# EAGLE board Copypaste (EAGLE 7.6.0), part 2 of 2
## Tracks (layer width: path | path; a pad name or v marks a point on that pad's centre or on a via)
A0  (1 unrouted)
A1  (1 unrouted)
A2  (1 unrouted)
A3  (1 unrouted)
A4
  Top 0.178: SJ4.2 16.73,71.18 17.53,70.38 17.53,63.3 16.15,61.92 16.15,60.33 16.76,59.72 18.21,59.72 18.29,59.64 18.44,59.64 U1.45
A5
  Top 0.178: SJ3.2 16.73,74.92 16.92,75.11 18.47,75.11 18.62,74.95 18.62,63.63 16.69,61.7 16.69,60.63 17.14,60.17 U1.46
A6
  Top 0.178: SJ2.2 16.73,76.92 16.92,77.11 18.82,77.11 19.02,76.89 19.02,63.37 18.72,63.07 18.69,63.07 17.17,61.54 17.17,60.91 17.37,60.71 18.46,60.71 U1.47
A7
  Top 0.178: U1.48 18.49,62.07 19.43,63.02 19.43,79.05 18.69,79.78 17.09,79.78 16.74,79.43 16.74,78.21 SJ1.2
A8  (1 unrouted)
A9  (1 unrouted)
A10  (1 unrouted)
A11  (1 unrouted)
C0  (3 unrouted)
C1  (3 unrouted)
C2  (3 unrouted)
C3  (3 unrouted)
C4  (3 unrouted)
C5  (3 unrouted)
C6  (3 unrouted)
C7  (3 unrouted)
C8  (3 unrouted)
C9  (3 unrouted)
C10  (3 unrouted)
C11  (3 unrouted)
C12  (2 unrouted)
C13  (via drill 0.5)
  Top 0.178: v0.91,89.56 4.29,89.56 4.65,89.92 4.65,91.15 R4.2 4.63,91.16 10.13,91.16 11.02,90.27 11.02,62.23 10.59,61.8 10.59,60.78 10.69,60.68 U1.2
  Bottom 0.178: C5.1 -1.69,88.79 -1.4,88.49 | -1.4,88.49 -1.4,86.52 C3.1 | -1.4,88.49 0.56,88.49 0.91,88.85 v0.91,89.56
C14  (via drill 0.5)
  Top 0.178: R6.2 4.43,86 v6.25,86 8.56,86 9.78,84.94 9.78,60.2 10.3,59.68 U1.4
  Bottom 0.178: C6.1 -1.3,84.72 C3.2 | C3.2 -1.27,79.84 C4.1 | C3.2 5.83,84.7 6.25,85.12 v6.25,86
C15  (via drill 0.5)
  Top 0.178: R11.2 4.25,74.09 v6.07,74.09 7.14,74.09 8.05,73.33 7.98,58.22 8.51,57.68 U1.8
  Bottom 0.178: C10.1 -0.94,74.11 C7.2 | C7.2 -0.91,71.26 C9.1 | C7.2 0.57,74.08 0.91,73.74 0.91,73.03 1.27,72.67 5.89,72.67 6.07,72.85 v6.07,74.09
C16  (via drill 0.5)
  Top 0.178: U1.12 6.45,55.68 6.17,56.03 6.17,61.37 5.71,61.82 | v1.27,60.94 1.8,60.4 5.36,60.4 5.71,60.76 5.71,61.82 | 5.71,61.82 5.71,64.17 R17.2
  Bottom 0.178: C16.1 -3.5,56.12 C15.1 C11.2 -0.16,58.45 0.91,58.45 1.27,58.8 v1.27,60.94
C17  (via drill 0.5)
  Top 0.178: U1.14 5.77,54.68 5.31,55.14 5.31,56.29 5.11,56.49 4.41,56.49 R23.2 4.29,56.43 4.29,55.42 3.94,55.07 v1.45,55.07
  Bottom 0.178: C14.1 -3.48,52.41 C13.1 C15.2 0.8,54.42 v1.45,55.07
C18  (via drill 0.5)
  Top 0.178: U1.16 5.8,53.68 5.36,53.31 5.36,52.22 5.18,52.05 4.65,52.05 4.47,51.87 4.15,51.87 R20.2 5.33,51.38 v5.51,51.21
  Bottom 0.178: C18.1 -1.3,48.6 C17.1 -0.86,48.27 -0.86,49.38 -0.2,50.04 C13.2 1,50.71 1.45,50.27 1.45,49.73 1.63,49.56 5.26,49.56 5.51,49.81 v5.51,51.21
C19  (via drill 0.5)
  Top 0.178: R29.2 4.43,38.53 v6.07,38.53 7.21,38.53 7.62,38.94 7.62,51.33 7.97,51.68 U1.20
  Bottom 0.178: C19.2 C23.1 | C24.1 -0.46,39.77 C23.1 | C23.1 5.8,39.51 6.07,39.24 v6.07,38.53
C20  (via drill 0.5)
  Top 0.178: R32.2 4.43,32.84 v6.07,32.84 8.2,32.84 8.64,33.27 8.64,50.37 8.95,50.68 U1.22
  Bottom 0.178: C25.1 C23.2 | C26.1 -0.28,35.8 C25.1 | C25.1 0.88,35.72 1.27,35.33 1.27,34.44 1.63,34.09 5.71,34.09 6.07,33.73 v6.07,32.84
C21  (via drill 0.5)
  Top 0.178: v5,28.4 5,26.91 R35.2 8.56,26.8 9.5,27.51 9.5,49.38 9.8,49.68 U1.24
  Bottom 0.178: C27.1 -0.27,25.02 -2.64,25.02 -3.4,25.78 C28.1 -3.37,32.13 -0.51,32.13 -0.2,32.44 C25.2 -0.2,27.74 0.38,27.15 1.8,27.15 2.87,28.22 4.83,28.22 v5,28.4
C22  (via drill 0.5)
  Top 0.178: R5.2 4.3,79.07 v5.89,79.07 8.03,79.07 8.92,78.18 8.92,59.06 9.29,58.68 U1.6
  Bottom 0.178: C8.1 -0.94,77.81 C4.2 | C4.2 C7.1 | C4.2 5.68,77.79 5.89,78 v5.89,79.07
C23  (via drill 0.5)
  Top 0.178: U1.26 19.49,50.18 19.58,50.09 19.58,49.02 17.63,47.07 v16.56,47.07 | v6.96,20.75 4.99,20.75 R38.2
  Bottom 0.178: C27.2 C29.1 6.34,21.37 v6.96,20.75 7.67,21.46 7.67,23.06 9.27,24.66 12.65,24.66 14.96,26.97 14.96,46.71 15.32,47.07 v16.56,47.07
C24  (via drill 0.5)
  Top 0.178: v1.63,42.8 4.11,42.8 4.29,42.98 4.29,44.23 R26.2 4.48,44.22 6.4,44.22 6.76,44.65 6.76,52.27 7.24,52.68 U1.18
  Bottom 0.178: C22.1 -1.04,46.39 C17.2 -0.91,45.34 -0.33,44.75 -0.33,43.55 C19.1 1,43.42 v1.63,42.8
C25  (via drill 0.5)
  Top 0.178: R14.2 4.2,69.29 5.89,69.29 6.07,69.11 v6.07,68.4 7.11,67.51 7.11,57.02 7.45,56.68 U1.10
  Bottom 0.178: C12.1 -1.14,69.33 C9.2 | C9.2 -1.07,62.38 -0.33,61.65 -0.33,60.31 C11.1 | C9.2 0.27,69.41 0.74,68.94 0.74,68.4 1.09,68.05 5.71,68.05 v6.07,68.4
C26  (2 unrouted)
C27  (3 unrouted)
C28  (3 unrouted)
C29  (3 unrouted)
C30  (3 unrouted)
C31  (3 unrouted)
C32  (3 unrouted)
C33  (3 unrouted)
C34  (3 unrouted)
C35  (3 unrouted)
C36  (3 unrouted)
C37  (3 unrouted)
C38  (3 unrouted)
DRIVE  (1 unrouted)
DRIVE1  (via drill 0.3)  (1 unrouted)
  Top 0.178: U1.38 16.34,56.18 15.24,57.28 v15.01,57.28
  Bottom 0.178: v15.01,57.28 15.01,65.66 16.08,66.73 16.08,67.72
DRIVE2  (1 unrouted)
GND  (18 unrouted)
GNDA  (18 unrouted)
GNDI  (via drill 0.5, 0.6)
  Top 0.178: U1.31 16.46,52.68
  other vias: 8.1,18.41 1.75,18.41 11.15,44.58 0.99,94.36 12.65,73.56 15.49,52.76 9.27,89.92 13.94,79.68 6.48,93.5 16.33,33.6 7.59,87.3 12.52,27.25 2.79,61.39 4.83,63.17
  pour Top: -13.74,111.89 19.58,111.71 19.28,-1.14 -13.74,-1.14
  pour Bottom: -13.74,114.43 19.28,114.43 19.28,-3.68 -13.74,-3.68
GPIO1  (2 unrouted)
GPIO2  (2 unrouted)
GPIO3  (2 unrouted)
GPIO4  (2 unrouted)
GPIO5  (1 unrouted)
GPIO6  (via drill 0.3)
  Top 0.178: R67.2 14.92,50.22 15.14,50.44 | 15.14,50.44 15.85,51.16 18.46,51.16 U1.28 | v14.96,50.8 15.14,50.44
  Bottom 0.178: v14.96,50.8 8.92,50.8 8.38,51.33 8.38,61.47 8.03,62 3.47,62 R72.P$2
GPIO7  (via drill 0.3, 0.5)
  Top 0.178: U1.27 16.56,50.68 | 16.56,50.68 16.26,50.68 15.67,50.09 15.67,38.13 R67.1 | R71.P$2 -7.94,93.8 v-7.98,93.83 | v16.56,50.17 16.56,50.68
  Bottom 0.178: v-7.98,93.83 -0.69,93.83 -0.33,94.18 -0.33,99.7 0.2,100.23 3.58,100.23 3.94,99.87 3.94,95.56 4.8,94.69 9.14,94.69 10.39,93.45 11.4,92.41 11.4,52.05 11.76,51.87 15.32,51.87 15.85,51.33 15.85,50.44 16.21,50.17 v16.56,50.17
GPIO8
  Top 0.178: R147.P$2 3.14,14.45 3.58,14.88 9.27,14.88 10.16,15.77 10.16,37.29 10.87,38 13.24,38 R67.4 13.41,38.03 13.41,39.95 13.42,52.28 14.76,53.62 15.98,53.62 16.41,53.18 U1.32
GPIO9  (via drill 0.5)
  Top 0.178: 14.09,38.06 R67.3 | U1.29 14.6,51.68 14.07,51.16 14.07,38.08 R67.3 | v11.73,36.37 11.94,36.4 12.65,37.11 13.89,37.11 14.07,37.29 14.07,37.98 R67.3
  Bottom 0.178: R73.P$2 -5.11,39.4 -4.45,38.66 4.62,38.66 5.18,38.18 5.18,37.47 5.54,37.11 11.05,37.11 v11.73,36.37
GPIO10
  Top 0.178: U1.33 19.45,53.68 19.66,53.47 19.66,50.62 19.96,50.32 19.96,48.74 17.42,46.2 17.42,30.61 16.41,29.59 16.41,29.09 R66.2
GPIO11  (2 unrouted)
GPIO12  (2 unrouted)
GPIO13  (2 unrouted)
GPIO14  (2 unrouted)
GPIO15  (1 unrouted)
IBIAS  (1 unrouted)
IBIAS1
  Top 0.178: R69.2 16.17,63.92 15.77,63.53 15.77,59.79 16.38,59.18 U1.44
IBIAS2  (1 unrouted)
ICMP  (2 unrouted)
ICMP1
  Top 0.178: R70.2 14.45,65.23 R69.1 14.47,63.99 15.01,63.45 15.01,59.72 16.08,58.67 18.52,58.67 U1.43
ICMP2  (2 unrouted)
IMA  (via drill 0.5)  (1 unrouted)
  Top 0.178: v12.47,94.01 12.47,90.63 12.83,90.27 18.41,90.27 TX1.3
  Bottom 0.178: -5.69,95.99 -0.51,101.12 4.29,101.12 4.7,101.52 9.93,101.52 10.44,101.02 10.44,94.59 11,94.03 12.45,94.03 v12.47,94.01
IMA1  (via drill 0.3)
  Top 0.178: U1.41 17.32,57.68 v16.92,57.28 | TX2.3 18.31,81.28 v16.92,81.28 16.28,81.92 R148.2
  Bottom 0.178: v16.92,57.28 16.92,57.35 17.45,57.89 18.75,57.89 18.9,58.04 18.9,80.67 18.75,80.82 17.37,80.82 v16.92,81.28
IMA2  (via drill 0.5)  (1 unrouted)
  Top 0.178: TX3.3 16.13,99.19 | 16.13,99.19 11.91,99.19 11.4,99.7 11.4,102.54 11.05,102.9 v8.03,102.9 | R1.2 16.18,100.94 16.18,100.89 16.13,100.89 16.13,99.19
  Bottom 0.178: v8.03,102.9 -0.69,102.9 -0.86,102.72 -7.09,96.85
IPA  (via drill 0.5)  (1 unrouted)
  Top 0.178: v11.58,95.43 18.39,95.43 TX1.1
  Bottom 0.178: -6.02,96.42 -0.51,102.01 10.52,102.01 10.87,101.65 10.87,96.14 v11.58,95.43
IPA1  (via drill 0.3)
  Top 0.178: U1.42 16.3,58.18 v16.08,57.96 | TX2.1 18.39,86.54 v16.69,86.54 16.28,86.13 R148.1
  Bottom 0.178: v16.08,57.96 16.38,58.27 17.07,58.27 17.22,58.42 18.29,58.42 18.44,58.57 18.44,79.91 18.14,80.21 16.38,80.21 16,80.59 16,85.85 v16.69,86.54
IPA2  (via drill 0.5)  (1 unrouted)
  Top 0.178: TX3.1 16.1,104.27 | 16.1,104.27 8.25,104.27 v8.03,104.5 | R1.1 16.1,102.64 16.1,104.27
  Bottom 0.178: v8.03,104.5 -1.04,104.5 -7.98,97.56
N$1
  Top 0.178: Q12.1 -2.75,88.07 -2.46,87.78 2.51,87.78 2.69,87.96 2.69,88.56 R7.1
N$2  (via drill 0.5)
  Top 0.178: -0.86,88.8 Q12.3
  Top 0.406: R64.P$2 -14.5,94.87 R65.P$2 | D1.A -5.87,89.71 -5.66,89.92 | -5.66,89.92 -1.22,89.92 -0.86,89.56 -0.86,88.8 | -5.66,89.92 -6.2,90.45 -6.2,94.72 -6.35,94.87 -9.04,94.87 v-9.14,94.77
  Bottom 0.406: v-9.14,94.77 -14.15,94.77 R64.P$2
N$3
  Top 0.178: -5.91,86.75 D1.C
  Top 0.406: R9.2 -5.91,86.75
N$4
  Top 0.178: -1.82,85.83 Q11.2 | -8.19,84.94 R9.1 | -14,91.52 R65.P$1
  Top 0.406: Q11.2 2.49,85.81 R6.1 | -1.82,85.83 -4.95,85.83 -5.13,85.65 -6.02,85.65 -6.38,85.29 -7.84,85.29 R9.1 | -8.19,84.94 -9.4,84.94 -9.58,85.12 -9.58,88.49 -10.64,89.56 -11.53,89.56 -12.07,90.09 -12.07,90.63 | -12.07,90.63 -12.07,90.98 -12.6,91.52 -14,91.52 | F26.2 -10.82,91.87 -12.07,90.63
  Bottom 0.406: R64.P$1 -17.36,94.87 R65.P$1
N$5
  Top 0.178: Q11.1 -2.75,82.92 -2.46,82.63 0.03,82.63 0.38,82.98 0.38,83.69 0.56,83.87 2.58,83.87 R8.1
N$6
  Top 0.178: -5.84,83.75 D2.A | -13.94,87.96 R62.P$2
  Top 0.406: R62.P$2 -14.25,88.01 R63.P$2 | Q11.3 -0.85,84.39 -1.22,84.76 -5.66,84.76 -5.84,84.58 | -5.84,84.58 -5.84,83.75 | -5.84,84.58 -6.73,84.58 -6.91,84.4 -6.91,83.69 -7.09,83.52 -9.83,83.52 -10.26,83.87 -10.26,87.61 -10.62,87.96 -13.94,87.96
N$7
  Top 0.178: -5.99,81.75 D2.C
  Top 0.406: R10.2 -5.99,81.75
N$8
  Top 0.178: -2.11,79 Q10.2 2.33,78.95 R5.1
  Top 0.406: -2.11,79 -2.11,79.6 -2.55,80.05 R10.1 -10.59,80.05 F27.2 -11.75,80 -11.89,80.14 -11.89,83.34 -12.42,83.87 -13.49,83.87 -13.84,84.23 -13.84,84.67 R63.P$1
  Bottom 0.406: R62.P$1 -17.1,88.01 R63.P$1
N$9
  Top 0.178: Q10.1 -3.01,76.24 -2.64,75.87 0.56,75.87 0.91,76.23 0.91,76.58 1.09,76.76 2.48,76.76 R12.1
N$10
  Top 0.178: -5.44,77.29 D3.A -5.66,77.17 | R60.P$2 -14.15,81.15
  Top 0.406: R60.P$2 -14.5,81.15 R61.P$2 | Q10.3 -1.11,77.54 -1.4,77.83 -3.89,77.83 -4.42,77.29 -5.44,77.29 | -14.15,81.15 -11.35,78.36 -6.02,78.36 -5.66,78 -5.66,77.17
N$11
  Top 0.178: -7.48,76.58 R13.2
  Top 0.406: D3.C -5.61,75.82 -5.84,76.05 -6.55,76.05 -6.73,76.23 -6.73,76.4 -6.91,76.58 -7.48,76.58
N$12  (via drill 0.5)
  Top 0.178: -1.86,73.56 Q9.2 -1.68,73.74
  Top 0.406: R11.1 1.27,74.12 | 1.27,74.12 -0.48,74.12 -0.86,73.74 -1.68,73.74 | v1.27,75.34 1.27,74.12 | F28.2 7.14,81.38 v7.32,81.2 | R61.P$1 -12.57,77.85 -11.13,76.4 -9.22,76.4 -8.69,75.87 -8.69,75.11 -8.53,74.95 -7.89,74.95 R13.1 -7.65,74.22 -7.09,73.66 -1.85,73.66 Q9.2
  Bottom 0.406: R60.P$1 -17.36,81.15 R61.P$1 | v7.32,81.2 7.32,75.69 6.96,75.34 v1.27,75.34
N$13
  Top 0.178: Q9.1 -2.75,70.83 -2.46,70.54 1.09,70.54 1.27,70.71 1.27,71.42 1.45,71.6 R15.1
N$14
  Top 0.178: -0.86,71.53 Q9.3 | -5.11,72.34 -5.11,72.49 | -13.92,74.62 R58.P$2
  Top 0.406: R58.P$2 -14,72.77 R59.P$2 | D4.A -5.11,72.34 -4.78,72.67 -1.04,72.67 -0.86,72.49 -0.86,71.53 | -13.92,74.62 -9.3,74.62 -7.16,72.49 -5.11,72.49
N$15
  Top 0.178: -5.23,69.56 D4.C
  Top 0.406: R16.2 -5.23,69.56
N$16
  Top 0.178: -1.89,67.86 Q8.2 | 2.35,69.29 R14.1
  Top 0.406: 2.35,69.29 -1.57,69.29 -1.8,69.06 Q8.2 -1.82,68.1 -2.74,68.1 -2.98,67.86 R16.1 -9.53,67.86 F29.2 -12.37,68.8 R59.P$1
  Bottom 0.406: R58.P$1 -17.75,74.17 R59.P$1
N$17
  Top 0.178: Q8.1 -2.75,65.44 -2.44,65.13 0,65.15 0.23,65.38 0.23,66.42 0.69,66.88 2.38,66.88 R18.1
N$18
  Top 0.178: -5.07,65.91 D5.A
  Top 0.406: R57.P$2 -13.49,65.15 R56.P$2 -6.53,66.42 -6.02,65.91 -5.07,65.91 | D5.A -4.85,66.73 -4.6,66.98 -1.22,66.98 -0.86,66.62 -0.86,65.99 Q8.3
N$19
  Top 0.178: -4.97,63.72 D5.C
  Top 0.406: R19.2 -4.97,63.72
N$20
  Top 0.178: Q6.1 -2.75,52.51 -2.64,52.4 1.45,52.4 1.63,52.58 1.63,53.47 1.98,53.82 2.58,53.82 R21.1
N$21
  Top 0.178: -4.78,53.82 D6.A
  Top 0.406: R52.P$2 -13.23,51.44 R53.P$2 -8.41,51.44 -7.98,51.87 -7.98,53.47 -7.62,53.82 -4.78,53.82 | D6.A -4.23,54.01 -3.71,54.53 -1.04,54.53 -0.86,54.36 -0.86,53.49 Q6.3
N$22
  Top 0.178: -6.5,51.91 R22.2
  Top 0.406: D6.C -6.5,51.91
N$23
  Top 0.178: -2.02,61.65 Q7.2 -1.8,61.85 -2.36,62.41 -2.36,64.21 -2.08,64.49 0.15,64.49 1.09,65.43 3.43,65.43 3.78,65.08 3.78,64.48 R17.1 | -7.23,62.1 R19.1
  Top 0.406: R19.1 -3.19,62.02 | -3.19,62.02 -2.82,61.65 -2.02,61.65 | R57.P$1 -7.23,62.1 | F30.2 -3.14,62.07 -3.19,62.02
  Bottom 0.178: R56.P$1 -17.1,66.42
  Bottom 0.406: -17.1,66.42 R57.P$1
N$24
  Top 0.178: Q7.1 -2.75,58.56 -2.46,58.27 1.09,58.27 1.45,58.62 1.45,59.16 1.63,59.33 2.66,59.33 R24.1
N$25
  Top 0.178: D7.A | -0.86,59.34 Q7.3
  Top 0.406: R55.P$2 R54.P$2 -8.05,58.55 -7.26,59.33 D7.A | D7.A -4.6,60.05 -4.24,60.4 -1.22,60.4 -0.86,60.05 -0.86,59.34
N$26
  Top 0.178: -6.5,57.24 R25.2
  Top 0.406: D7.C -6.5,57.24
N$27
  Top 0.178: -6.85,55.19 R25.1 | -1.82,55.6 Q6.2 -1.8,56.44 -1.57,56.67 2.53,56.67 R23.1
  Top 0.406: R25.1 -3.54,55.41 -3.35,55.6 -1.82,55.6 | -6.85,55.19 -7.39,55.19 -9.04,56.84 -10.93,56.84 R55.P$1 -10.96,53.17 F31.2
  Bottom 0.406: R54.P$1 -16.34,58.55 R55.P$1
N$28
  Top 0.178: -6.55,50 R22.1
  Top 0.406: R22.1 -1.63,50.08 Q5.2 0.5,50 F32.2 2.02,50.23 2.36,50.57 2.36,51.37 R20.1 | R52.P$1 -7.09,48.13 -6.55,48.67 -6.55,50
  Bottom 0.406: R53.P$1 -16.09,51.44 R52.P$1
N$29
  Top 0.178: Q5.1 -2.58,48.73 -2.29,49.02 -0.33,49.02 0.03,49.38 2.34,49.38 2.69,49.02 2.69,48.4 R27.1
N$30
  Top 0.178: -4.74,48.31 D9.A
  Top 0.406: R51.P$2 R50.P$2 -12.98,45.82 -12.8,46 -7.77,46 -7.62,46.15 -7.62,47.07 -7.26,47.42 -6.02,47.42 -5.66,47.78 -5.66,48.13 -5.49,48.31 -4.74,48.31 | D9.A -4.6,48.84 -4.24,49.2 -3.89,49.2 -3.53,48.84 -3.53,47.07 -3.35,46.89 -1.04,46.89 -0.86,47.07 -0.86,47.89 Q5.3
N$31
  Top 0.178: -6.5,46.07 R28.2
  Top 0.406: D9.C -6.5,46.07
N$32
  Top 0.178: 2.6,44.4 R26.1 | -12.68,41.38 R51.P$1
  Top 0.406: 2.6,44.4 1.27,44.4 0.77,43.9 Q4.2 -2.14,44.23 R28.1 -9.22,44.23 | -9.22,44.23 -10.45,44.23 -11.18,43.51 -11.18,41.73 -11.53,41.38 -12.68,41.38 | F33.2 -9.22,44.23
  Bottom 0.406: R50.P$1 -16.34,44.83 R51.P$1
N$33
  Top 0.178: Q4.1 -2.75,40.95 -2.46,40.67 0.91,40.67 1.45,41.2 2.6,41.2 R30.1
N$34  (via drill 0.5)
  Top 0.178: D10.A -4.08,42.07 | -0.86,41.81 Q4.3
  Top 0.406: -4.08,42.07 -3.53,42.8 -1.04,42.8 -0.86,42.62 -0.86,41.81 | D10.A -6.6,42.07 v-6.63,42.04 | R49.P$2 -17.12,34.67 R48.P$2
  Bottom 0.406: v-6.63,42.04 -10.13,42.04 -12.73,39.45 -12.73,38.23 -13.06,37.9 R48.P$2
N$35
  Top 0.178: -6.51,39.97 R31.2
  Top 0.406: D10.C -6.51,39.97
N$36
  Top 0.178: 2.63,38.53 R29.1
  Top 0.406: 1.09,38.53 0.3,39.33 Q2.2 -3.4,39.33 -3.73,38.84 -5.21,38.84 -5.84,38.35 -6.59,38.35 R31.1 -6.55,38.32 -6.55,37.85 -6.93,37.47 -7.62,37.47 -8.76,36.32 -10.06,36.32 -10.52,35.86 -10.52,35.18 -11.02,34.67 R49.P$1 | 1.09,38.53 2.63,38.53 | 1.09,38.53 1.09,37.57 1.68,36.98 3.05,36.98 3.53,36.5 3.53,31.8 3.17,31.45 1.88,31.45 1.73,31.6 1.73,31.64 1.07,32.3 F34.2
  Bottom 0.406: R48.P$1 -17.38,37.9 R49.P$1
N$37
  Top 0.178: Q2.1 -2.5,36.08 -2.11,35.69 R33.1
N$38
  Top 0.406: R47.P$2 -13.49,31.37 R46.P$2 -12.6,31.75 -8.38,31.75 -8.08,32.06 -8.08,35.86 -7.62,36.32 -6.17,36.32 -5.94,36.55 -5.94,36.86 -5.55,37.25 D11.A -4.6,38 -4.42,38.18 -0.86,38.18 -0.6,37.91 Q2.3
N$39
  Top 0.178: -4.72,35.27 D11.C
  Top 0.406: R34.2 -4.72,35.27
N$40  (via drill 0.5)
  Top 0.178: -6.55,33.48 R34.1
  Top 0.406: R34.1 -6.63,31.52 -7.26,30.89 -10.11,30.89 -10.64,30.35 -10.64,28.4 -11,28.04 -13.01,28.04 R47.P$1 | R32.1 2.09,33.48 Q1.2 -6.55,33.48 | v-4.78,26.09 -4.78,25.73 -5.31,25.2 -6.24,25.2 F35.2
  Bottom 0.178: -13.01,28.04 R47.P$1
  Bottom 0.406: R46.P$1 -16.34,31.37 R47.P$1 | -13.01,28.04 -9.93,28.04 -8.15,26.26 -4.95,26.26 v-4.78,26.09
N$41
  Top 0.178: Q1.1 -3.03,30.67 -2.72,30.35 -0.61,30.35 -0.38,30.58 -0.38,31.37 -0.13,31.45 1.17,31.45 1.42,31.19 1.42,30.43 1.7,30.15 3.14,30.15 R36.1
N$42
  Top 0.406: R45.P$2 -13.2,25.02 R44.P$2 -11,25.02 -10.82,25.2 -10.82,27.15 -7.8,30.18 -6.2,30.18 -5.84,30.53 -5.84,31.06 -5.66,31.24 -4.69,31.24 D12.A -4.6,32.13 -4.24,32.49 -1.4,32.49 -1.22,32.31 -1.22,31.47 Q1.3
N$43
  Top 0.178: -6.76,29.05 R37.2
  Top 0.406: D12.C -6.76,29.05
N$44
  Top 0.178: Q3.1 -2.5,22.92 -2.11,22.53 1.45,22.53 1.98,23.06 1.98,23.6 2.16,23.77 3.16,23.77 R39.1
N$45
  Top 0.178: -6.51,21.68 R40.2
  Top 0.406: D13.C -6.51,21.68
N$46
  Top 0.178: 2.51,90.89 R4.1 2.87,91.25 | 2.87,92.33 10.64,92.33 11.43,91.54 11.46,68.35 11.76,68.05 12.79,68.05 R2.1 R3.1
  Top 0.406: Q12.2 2.51,90.89 | 2.87,91.25 2.87,92.33 2.87,105.56 2.91,105.56 F25.2
N$47
  Top 0.178: -0.51,23.86 Q3.3 | -7.98,18.65 -8.08,18.55
  Top 0.406: R43.P$2 -8.08,18.55 -7.62,18.09 R42.P$2 | -0.51,23.86 -0.51,24.49 -0.86,24.84 -4.24,24.84 -4.6,24.49 D13.A -7.43,23.78 -7.98,23.24 -7.98,18.65
N$48
  Top 0.178: R42.P$1 | R38.1 3.19,17.36 2.87,17.04 R41.1 3.4,17
  Top 0.406: R40.1 -6.63,17.98 -5.13,16.48 | -5.13,16.48 -5.13,14.17 -6.2,13.11 -9.4,13.11 -9.93,13.64 -10.82,13.64 -11.35,14.17 R42.P$1 | 2.87,17.04 -1.17,17.04 | -1.17,17.04 -4.58,17.04 -5.13,16.48 | U$1.1 0.26,6.6 -0.81,7.67 -0.81,16.68 -1.17,17.04
  Bottom 0.178: -11.43,15.42 R42.P$1
  Bottom 0.406: R43.P$1 -16.85,16.11 -16.15,15.42 -11.43,15.42
N$49
  Top 0.178: -1.57,25.89 Q3.2 | 3.01,26.62 R35.1 | -12.63,21.82 R45.P$1
  Top 0.406: -1.57,25.89 -1.57,27.15 -1.89,27.47 R37.1 -9.33,27.47 -9.75,26.97 -9.75,22.35 -10.29,21.82 -12.63,21.82 | Q3.2 1.4,25.86 2.16,26.62 3.01,26.62 | F36.2 3.82,15.56 4.24,15.98 4.24,19.74 4.04,19.94 4.04,24.89 3.33,25.6 3.33,26.66 R35.1
  Bottom 0.406: R44.P$1 -15.83,25.02 R45.P$1
N$50  (via drill 0.3)  (1 unrouted)
  Top 0.406: R2.2 14.25,69.79 14.34,69.87 14.34,70.31 | C2.1 14.34,70.31 | v15.09,70.31 14.34,70.31
  Bottom 0.178: 15.13,70.04 15.39,70.31 v15.09,70.31
N$52
  Top 0.178: R67.8 R67.7 R67.6 R67.5 13.36,36.37 13.36,36.4 13.16,36.2
  Top 0.406: Q13.3 13.16,36.17 R67.5
N$53
  Top 0.178: R68.1 13.12,28.99 13.16,28.95 | 13.18,28.93 14.54,28.93 R66.1
  Top 0.406: Q13.1 13.16,28.95 13.18,28.93
N$55  (1 unrouted)
N$56  (3 unrouted)
N$57  (1 unrouted)
N$58  (5 unrouted)
N$59  (1 unrouted)
N$60  (3 unrouted)
N$61  (1 unrouted)
N$62  (5 unrouted)
N$63  (1 unrouted)
N$64  (3 unrouted)
N$65  (1 unrouted)
N$66  (5 unrouted)
N$67  (1 unrouted)
N$68  (3 unrouted)
N$69  (1 unrouted)
N$70  (5 unrouted)
N$71  (1 unrouted)
N$72  (3 unrouted)
N$73  (1 unrouted)
N$74  (1 unrouted)
N$75  (3 unrouted)
N$76  (1 unrouted)
N$77  (5 unrouted)
N$78  (1 unrouted)
N$79  (3 unrouted)
N$80  (1 unrouted)
N$81  (5 unrouted)
N$82  (5 unrouted)
N$83  (1 unrouted)
N$84  (3 unrouted)
N$85  (1 unrouted)
N$86  (5 unrouted)
N$87  (1 unrouted)
N$88  (3 unrouted)
N$89  (1 unrouted)
N$90  (5 unrouted)
N$91  (1 unrouted)
N$92  (3 unrouted)
N$93  (1 unrouted)
N$94  (5 unrouted)
N$95  (1 unrouted)
N$96  (3 unrouted)
N$97  (1 unrouted)
N$98  (1 unrouted)
N$99  (1 unrouted)
N$100  (4 unrouted)
N$101  (3 unrouted)
N$102  (1 unrouted)
N$103  (3 unrouted)
N$104  (1 unrouted)
N$105  (5 unrouted)
N$106  (5 unrouted)
N$107  (2 unrouted)
N$108  (5 unrouted)
N$110  (1 unrouted)
N$111  (3 unrouted)
N$112  (1 unrouted)
N$113  (5 unrouted)
N$114  (4 unrouted)
N$115  (1 unrouted)
N$116  (3 unrouted)
N$117  (1 unrouted)
N$118  (5 unrouted)
N$119  (2 unrouted)
N$121  (1 unrouted)
N$122  (3 unrouted)
N$123  (1 unrouted)
N$124  (5 unrouted)
N$125  (via drill 0.6)
  Top 0.406: TX3.6 v22.58,104.27 | TX2.6 v23.09,86.49 | TX1.6 v22.83,95.38
  Bottom 0.406: J2.1 23.09,107.01 23.09,105.54 23.09,104.52 | 23.09,104.52 23.09,95.38 | 23.09,95.38 v23.09,86.49 23.11,5.06 J1.2 | v22.58,104.27 22.83,104.27 23.09,104.52 | 23.09,95.38 v22.83,95.38
N$126  (1 unrouted)
N$127  (3 unrouted)
N$128  (1 unrouted)
N$129  (via drill 0.6)
  Top 0.406: TX3.4 v24.36,99.19 | TX2.4 v24.36,81.41 | TX1.4 v24.36,90.3
  Bottom 0.305: 24.38,4.65 24.38,4.69 J1.1
  Bottom 0.406: 24.38,4.65 v24.36,81.41 v24.36,90.3 v24.36,99.19 24.38,106.87 J2.2
N$130  (1 unrouted)
N$131  (3 unrouted)
N$132  (1 unrouted)
N$133  (1 unrouted)
N$134  (5 unrouted)
N$135  (via drill 0.3)
  Top 0.178: v19.91,54.69 U1.35
  Bottom 0.178: 19.05,54.66 19.86,54.66 v19.91,54.69
  Bottom 0.406: C30.1 18.68,54.29 19.05,54.66
N$136  (1 unrouted)
N$137  (3 unrouted)
N$138  (1 unrouted)
N$139  (5 unrouted)
N$142  (5 unrouted)
N$144  (1 unrouted)
N$145  (3 unrouted)
N$146  (1 unrouted)
N$147  (5 unrouted)
N$149  (1 unrouted)
N$150  (3 unrouted)
N$151  (1 unrouted)
N$152  (5 unrouted)
N$154  (1 unrouted)
N$155  (3 unrouted)
N$156  (1 unrouted)
N$159  (5 unrouted)
N$161  (1 unrouted)
N$162  (3 unrouted)
N$163  (1 unrouted)
N$165  (1 unrouted)
N$166  (1 unrouted)
N$170  (4 unrouted)
N$175  (3 unrouted)
N$176  (6 unrouted)
  Top 0.178: -44.6,4.93 -40.89,4.93
N$177  (5 unrouted)
N$178  (2 unrouted)
N$192  (4 unrouted)
N$193  (2 unrouted)
N$262  (1 unrouted)
N$264  (1 unrouted)
N$286  (1 unrouted)
N$287  (1 unrouted)
N$288  (1 unrouted)
N$289  (1 unrouted)
N$290  (1 unrouted)
N$291  (1 unrouted)
N$292  (1 unrouted)
N$293  (1 unrouted)
N$294  (1 unrouted)
N$295  (1 unrouted)
N$296  (1 unrouted)
N$297  (1 unrouted)
N$298  (1 unrouted)
N$299  (1 unrouted)
N$300  (1 unrouted)
N$301  (1 unrouted)
N$302  (1 unrouted)
N$303  (1 unrouted)
N$304  (1 unrouted)
N$305  (1 unrouted)
N$306  (1 unrouted)
N$307  (1 unrouted)
N$308
  Top 0.406: U$2.1 1.45,13.68 F36.1
N$309
  Top 0.406: U$3.1 -9.37,21.31 -8.86,21.82 -8.86,23.95 -8.33,24.49 -8.33,25.51 F35.1
N$310
  Top 0.406: U$4.1 0.48,29.91 F34.1
N$311
  Top 0.406: U$5.1 -9.36,38.49 -9.75,38.89 -9.75,40.7 F33.1
N$312
  Top 0.406: F32.1 0.74,47.16 U$6.1
N$313
  Top 0.406: U$7.1 -9.38,53.23 F31.1
N$314
  Top 0.406: F30.1 -0.69,63.42 -0.15,63.96 1.44,63.96 U$8.1
N$315
  Top 0.406: F29.1 -10.46,72.14 -9.93,72.67 -9.4,72.67 U$9.1
N$316
  Top 0.406: U$10.1 3.75,81.43 F28.1
N$317  (via drill 0.5)
  Top 0.406: F27.1 -10.64,83.16 -11.53,84.05 v-11.53,86
  Bottom 0.406: v-11.53,86 -11.53,89.92 -11.18,90.27 -9.45,90.27 U$11.1
N$318
  Top 0.406: F26.1 0.88,95.74 1.45,96.32 1.45,98.92 U$12.1
N$319
  Top 0.406: F25.1 8.21,106.81 U$13.1
S1  (1 unrouted)
S2  (1 unrouted)
S3  (1 unrouted)
S4  (1 unrouted)
S5  (1 unrouted)
S6  (1 unrouted)
S7  (1 unrouted)
S8  (1 unrouted)
S9  (1 unrouted)
S10  (1 unrouted)
S11  (1 unrouted)
S12  (1 unrouted)
S13
  Top 0.178: R7.2 4.48,88.49 9.09,88.49 10.21,87.61 10.21,60.4 10.43,60.18 U1.3
S14
  Top 0.178: R8.2 4.33,83.87 8.2,83.87 9.35,83.11 9.35,59.44 9.6,59.18 U1.5
S15
  Top 0.178: R12.2 4.36,76.58 7.67,76.58 8.48,75.77 8.48,58.45 8.51,58.45 8.84,58.12 11.58,58.12 U1.7
S16
  Top 0.178: R15.2 6.78,71.6 7.54,70.84 7.54,57.28 7.77,57.12 11.59,57.12 U1.9
S17
  Top 0.178: U1.11 6.91,56.18 6.68,56.49 6.68,66.62 6.25,66.98 4.18,66.98 R18.2
S18
  Top 0.178: R21.2 5.08,53.72 5.54,54.18 U1.15
S19
  Top 0.178: U1.13 6.08,55.18 5.74,55.52 5.74,58.73 5.38,59.16 4.53,59.16 R24.2
S20
  Top 0.178: U1.17 6.85,53.18 6.32,52.65 6.32,48.82 5.99,48.49 4.48,48.49 R27.2
S21
  Top 0.178: U1.19 7.58,52.18 7.19,51.87 7.19,41.71 6.76,41.2 4.46,41.2 R30.2
S22
  Top 0.178: U1.21 8.59,51.18 8.2,50.8 8.2,36.04 7.85,35.69 R33.2
S23
  Top 0.178: U1.23 9.34,50.18 9.07,49.91 9.07,30.58 8.56,30 4.99,30 R36.2
S24  (via drill 0.3, 0.5)
  Top 0.178: U1.25 18.49,49.17 17.98,48.67 16.74,48.67 v16.56,48.49 | v6.96,23.77 4.96,23.77 R39.2
  Bottom 0.178: v16.56,48.49 14.78,48.49 14.43,48.13 14.43,27.15 12.47,25.2 8.38,25.2 v6.96,23.77
S25  (1 unrouted)
S26  (1 unrouted)
S27  (1 unrouted)
S28  (1 unrouted)
S29  (1 unrouted)
S30  (1 unrouted)
S31  (1 unrouted)
S32  (1 unrouted)
S33  (1 unrouted)
S34  (1 unrouted)
S35  (1 unrouted)
S36  (1 unrouted)
SWTEN  (1 unrouted)
SWTEN1  (via drill 0.3)
  Top 0.178: U1.36 13.83,55.18 v13.26,55.91
  Bottom 0.178: v13.26,55.91 13.03,56.24 13.03,57.63 SJ5.1
SWTEN2  (1 unrouted)
V+  (2 unrouted)
V+1  (via drill 0.5)
  Top 0.178: U1.1 11.65,63.84 12.33,64.53 R3.2 v12.83,63.25
  Bottom 0.178: C1.1 12.85,63.09 v12.83,63.25
V+2  (2 unrouted)
VREF1  (1 unrouted)
VREF2  (3 unrouted)
VREF4  (via drill 0.5)
  Top 0.178: U1.34 16.94,54.18 v16.64,54.15
  Top 0.305: v13.16,54.05 13.16,53.11 12.85,52.81 12.85,39.95 v12.32,39.42 | v11.07,33.96 11.07,32.24 Q13.2
  Top 0.406: Q13.2 11.06,29.27 11.23,29.11 11.23,29.03 R68.2
  Bottom 0.178: v16.64,54.15 15.19,54.15 C31.1 13.1,54.11 v13.16,54.05
  Bottom 0.305: v12.32,39.42 12.32,39.06 12.93,38.46 12.93,34.75 12.34,34.16 11.28,34.16 v11.07,33.96
VREF6  (3 unrouted)
VREG  (9 unrouted)
VREG1  (via drill 0.3)  (2 unrouted)
  Top 0.178: SJ1.1 17.54,78.63 v17.68,78.69 | v17.68,76.33 17.6,76.19 SJ2.1 17.54,75.78 17.6,75.72 | SJ3.1 17.54,74.44 v17.68,74.35 | SJ4.1 17.54,72.3 v17.68,72.29 | 16.08,55.68 U1.37 18.51,55.7 19.58,55.7 19.74,55.86 19.74,57.02 19.58,57.18 U1.40
  Top 0.254: 16.08,55.68 15.24,55.68 14.68,56.24 14.5,56.24 v14.48,56.21
  Bottom 0.178: v17.68,78.69 v17.68,76.33 17.75,76.33 17.68,76.1 v17.68,74.35 v17.68,72.29 17.6,72.29 17.6,69.32 17.14,68.86 14.4,68.86 14.18,68.64 | SJ5.2 14.14,57.64 14.18,57.61
  Bottom 0.406: v14.48,56.21 14.18,56.51 14.18,57.61 14.18,65.68 14,65.5 C32.1
VREG2  (9 unrouted)

## Text on the board
tNames: G. Reinbolt / R. Johnson